# EasyEDA Pro project 3SE_24_Power_Rune.eprj, board 深大PCB参考 (continued)
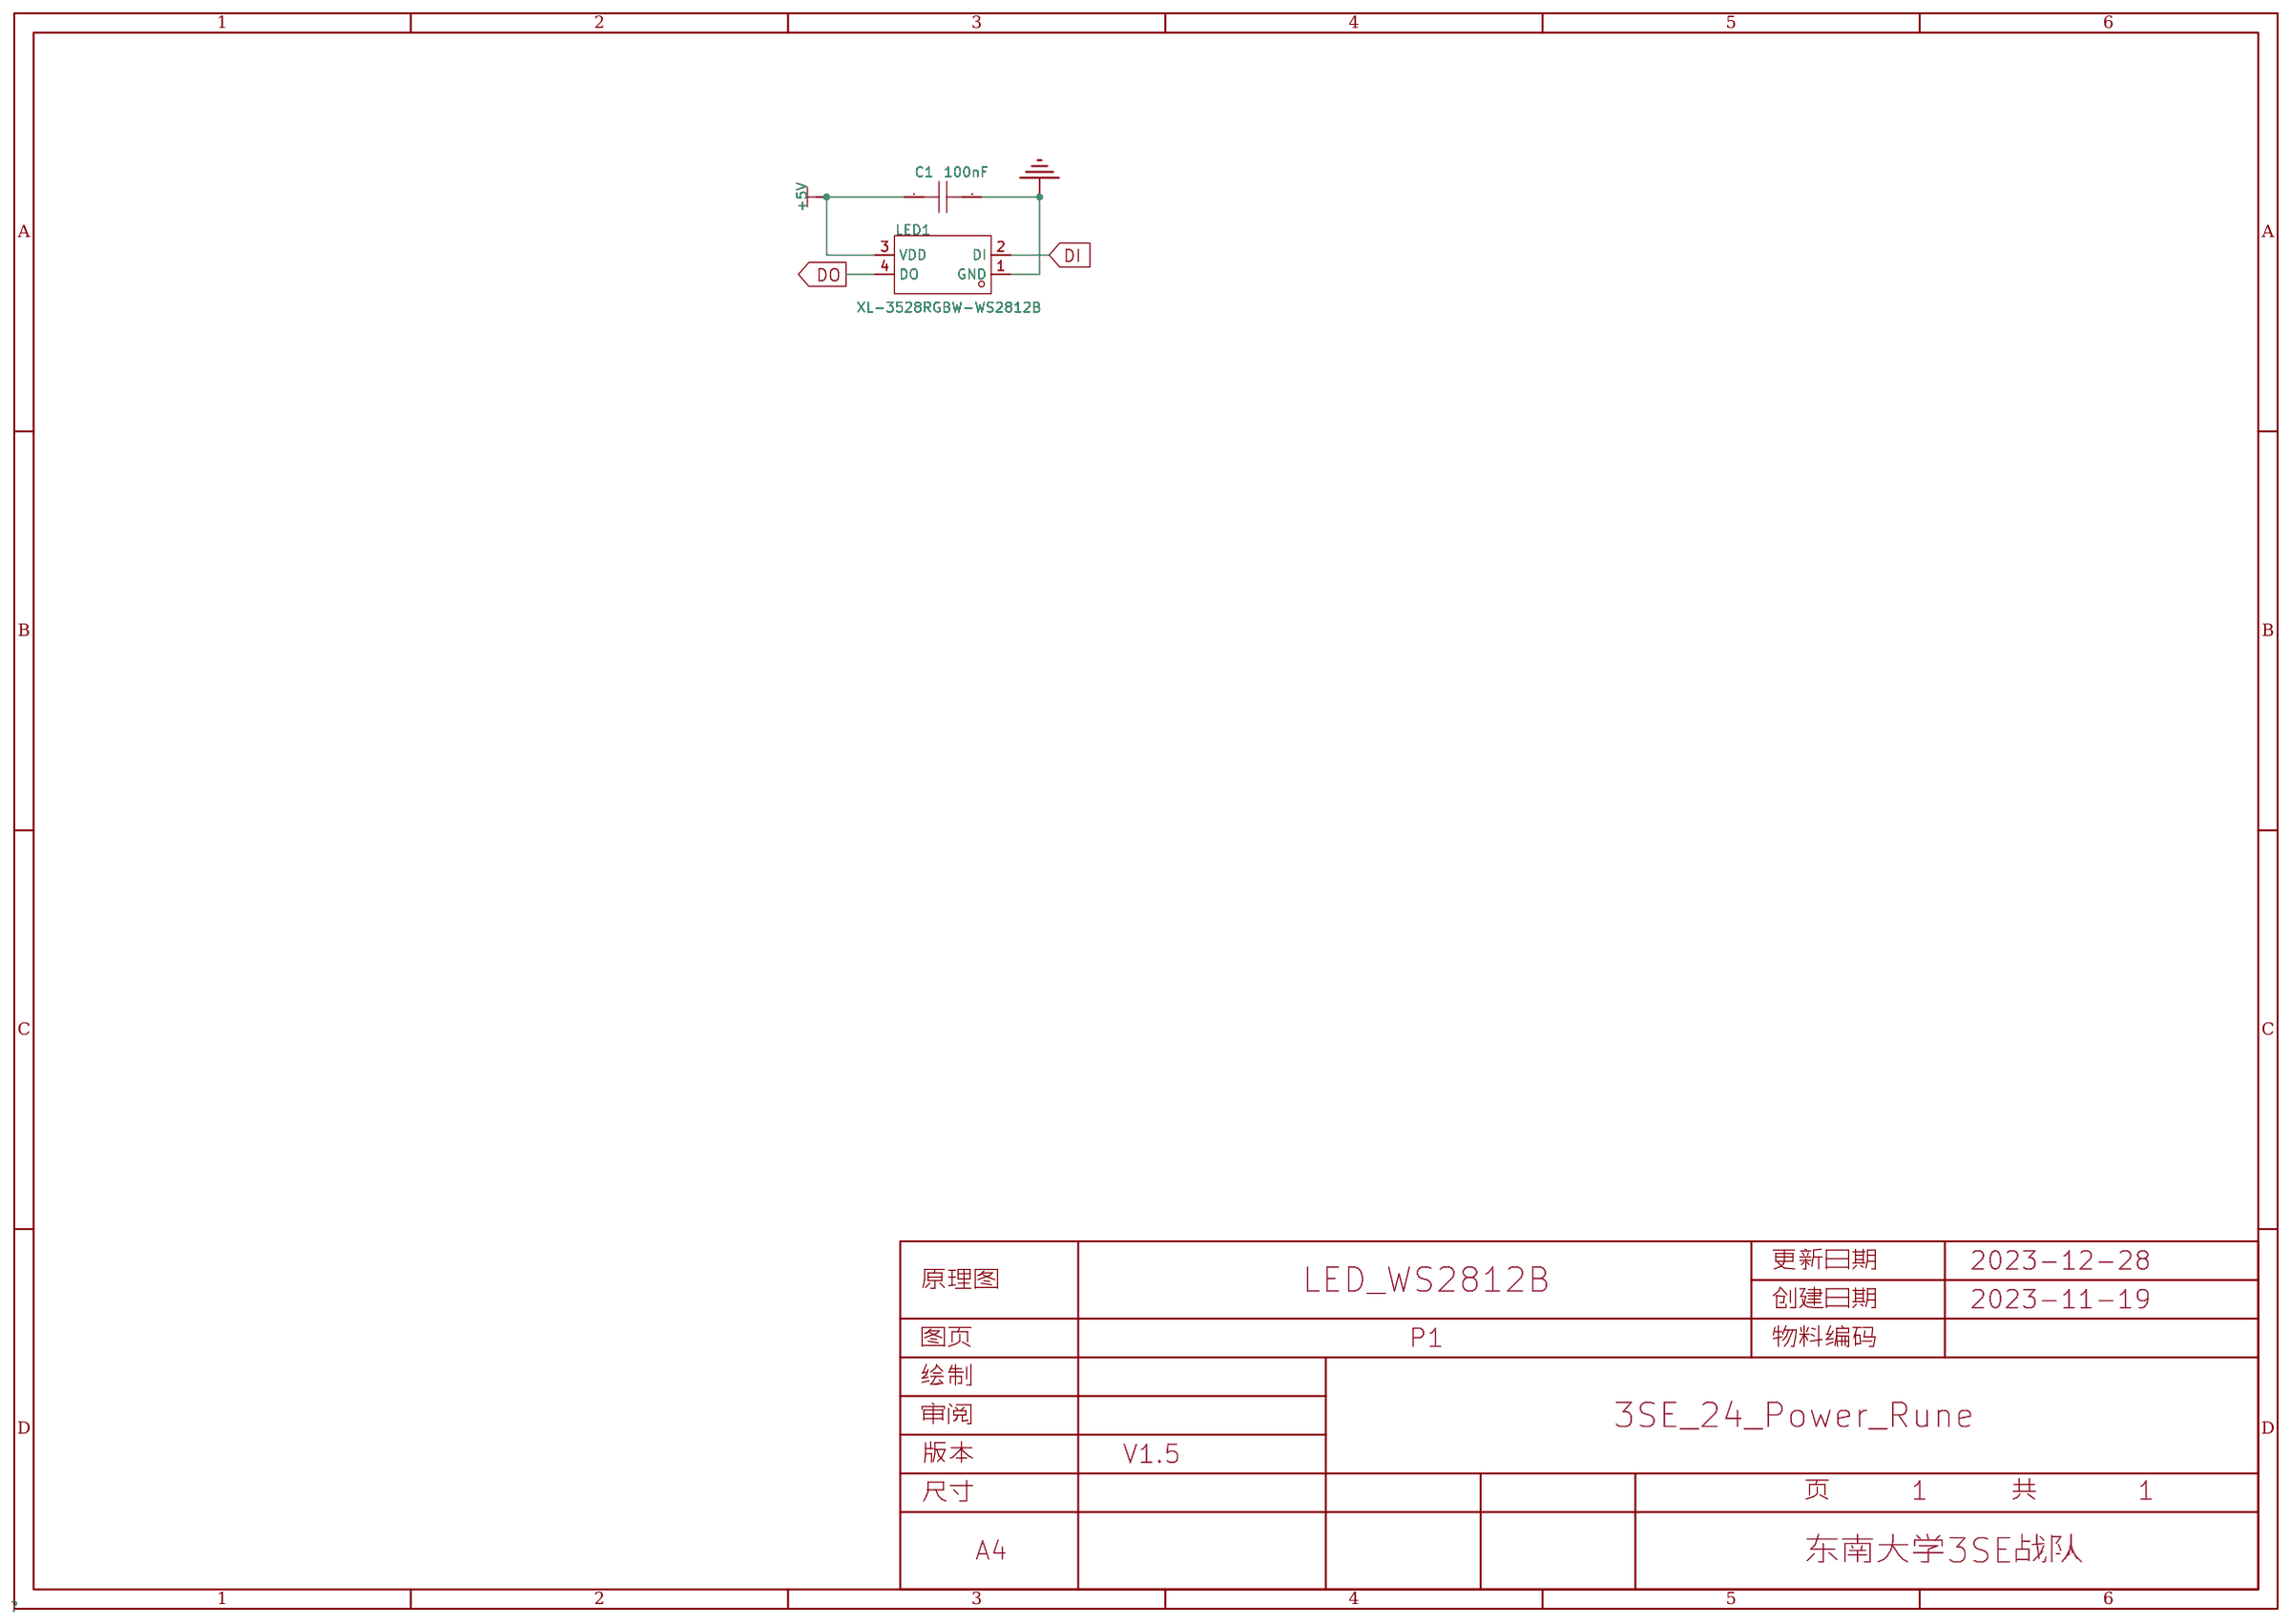
[diagram p0: schematic sheet]
## Nets (continued)
NETD263_2: D263.2 D264.4
NETD264_2: D264.2 D265.4
NETD265_2: D265.2 D266.4
NETD266_2: D266.2 D267.4
NETD267_2: D267.2 D268.4
NETD268_2: D268.2 D269.4
NETD269_2: D269.2 D270.4
NETD270_2: D270.2 D271.4
NETD271_2: D271.2 D272.4
NETD272_2: D272.2 D273.4
NETD273_2: D273.2 D274.4
NETD274_2: D274.2 D275.4
NETD275_2: D275.2 D276.4
NETD276_2: D276.2 D277.4
NETD277_2: D277.2 D278.4
NETD278_2: D278.2 D279.4
NETD279_2: D279.2 D280.4
NETD280_2: D280.2 D281.4
NETD281_2: D281.2 D282.4
NETD282_2: D282.2 D283.4
NETD283_2: D283.2 D284.4
NETD284_2: D284.2 D285.4
NETD285_2: D285.2 D286.4
NETD286_2: D286.2 D287.4
NETD287_2: D287.2 D288.4
NETD288_2: D288.2 D289.4
NETD289_2: D289.2 D290.4
NETD290_2: D290.2 D291.4
NETD291_2: D291.2 D292.4
NETD292_2: D292.2 D293.4
NETD293_2: D293.2 D294.4
NETD294_2: D294.2 D295.4
NETD295_2: D295.2 D296.4
NETD296_2: D296.2 D297.4
NETD297_2: D297.2 D298.4
NETD298_2: D298.2 D299.4
NETD299_2: D299.2 D300.4
NETD300_2: D300.2 D301.4
NETD301_2: D301.2 D302.4
NETD302_2: D302.2 D303.4
NETD303_2: D303.2 D304.4
NETD304_2: D304.2 D305.4
NETD305_2: D305.2 D306.4
NETD306_2: D306.2 D307.4
NETD307_2: D307.2 D308.4
NETD308_2: D308.2 D309.4
NETD309_2: D309.2 D310.4
NETD310_2: D310.2 D311.4
NETD311_2: D311.2 D312.4
NETD312_2: D312.2 D313.4
NETD313_2: D313.2 D314.4
NETD314_2: D314.2 D315.4
NETD315_2: D315.2 D316.4
NETD316_2: D316.2 D317.4
NETD317_2: D317.2 D318.4
NETD318_2: D318.2 D319.4
NETD319_2: D319.2 D320.4
NETD320_2: D320.2 D321.4
NETD321_2: D321.2 D322.4
NETD322_2: D322.2 D323.4
NETD323_2: D323.2 D324.4
NETD324_2: D324.2 D325.4
NETD325_2: D325.2 D326.4
NETD326_2: D326.2 D327.4
NETD327_2: D327.2 D328.4
NETD328_2: D328.2 D329.4
NETD329_2: D329.2 D330.4
NETD330_2: D330.2 D331.4
NETD331_2: D331.2 D332.4
NETD332_2: D332.2 D333.4
NETD333_2: D333.2 D334.4
NETD334_2: D334.2 D335.4
NETD335_2: D335.2 D336.4
NETD336_2: D336.2 D337.4
NETD337_2: D337.2 D338.4
NETD338_2: D338.2 D339.4
NETD339_2: D339.2 D340.4
NETD340_2: D340.2 D341.4
NETD341_2: D341.2 D342.4
NETD342_2: D342.2 D343.4
NETD343_2: D343.2 D344.4
NETD344_2: D344.2 D345.4
NETD345_2: D345.2 D346.4
NETD346_2: D346.2 D347.4
NETD347_2: D347.2 D348.4
NETD348_2: D348.2 D349.4
NETD349_2: D349.2 D350.4
NETD350_2: D350.2 D351.4
NETD351_2: D351.2 D352.4
NETD352_2: D352.2 D353.4
NETD353_2: D353.2 D354.4
NETD354_2: D354.2 D355.4
NETD355_2: D355.2 D356.4
NETD357_2: D357.2 D358.4
NETD358_2: D358.2 D359.4
NETD359_2: D359.2 D360.4
NETD360_2: D360.2 D361.4
NETD361_2: D361.2 D362.4
NETD362_2: D362.2 D363.4
NETD363_2: D363.2 D364.4
NETD364_2: D364.2 D365.4
NETD365_2: D365.2 D366.4
NETD366_2: D366.2 D367.4
NETD367_2: D367.2 D368.4
NETD368_2: D368.2 D369.4
NETD369_2: D369.2 D370.4
NETD370_2: D370.2 D371.4
NETD371_2: D371.2 D372.4
NETD372_2: D372.2 D373.4
NETD373_2: D373.2 D374.4
NETD374_2: D374.2 D375.4
NETD375_2: D375.2 D376.4
NETD376_2: D376.2 D377.4
NETD377_2: D377.2 D378.4
NETD378_2: D378.2 D379.4
NETD379_2: D379.2 D380.4
NETD380_2: D380.2 D381.4
NETD381_2: D381.2 D382.4
NETD382_2: D382.2 D383.4
NETD383_2: D383.2 D384.4
NETD384_2: D384.2 D385.4
NETD385_2: D385.2 D386.4
NETD386_2: D386.2 D387.4
NETD387_2: D387.2 D388.4
NETD388_2: D388.2 D389.4
NETD389_2: D389.2 D390.4
NETD390_2: D390.2 D391.4
NETD391_2: D391.2 D392.4
NETD392_2: D392.2 D393.4
NETD393_2: D393.2 D394.4
NETD394_2: D394.2 D395.4
NETD395_2: D395.2 D396.4
NETD396_2: D396.2 D397.4
NETD397_2: D397.2 D398.4
NETD398_2: D398.2 D399.4
NETD399_2: D399.2 D400.4
NETD400_2: D400.2 D401.4
NETD401_2: D401.2 D402.4
NETD402_2: D402.2 D403.4
NETD403_2: D403.2 D404.4
NETD404_2: D404.2 D405.4
NETD405_2: D405.2 D406.4
NETD406_2: D406.2 D407.4
NETD407_2: D407.2 D408.4
NETD408_2: D408.2 D409.4
NETD409_2: D409.2 D410.4
NETD410_2: D410.2 D411.4
NETD411_2: D411.2 D412.4
NETD412_2: D412.2 D413.4
NETD413_2: D413.2 D414.4
NETD414_2: D414.2 D415.4
NETD415_2: D415.2 D416.4
NETD416_2: D416.2 D417.4
NETD417_2: D417.2 D418.4
NETD418_2: D418.2 D419.4
NETD419_2: D419.2 D420.4
NETD420_2: D420.2 D421.4
NETD421_2: D421.2 D422.4
NETD422_2: D422.2 D423.4
NETD423_2: D423.2 D424.4
NETD424_2: D424.2 D425.4
NETD425_2: D425.2 D426.4
NETD426_2: D426.2 D427.4
NETD427_2: D427.2 D428.4
NETD428_2: D428.2 D429.4
NETD429_2: D429.2 D430.4
NETD430_2: D430.2 D431.4
NETD431_2: D431.2 D432.4
NETD432_2: D432.2 D433.4
NETD433_2: D433.2 D434.4
NETD434_2: D434.2 D435.4
NETD435_2: D435.2 D436.4
NETD436_2: D436.2 D437.4
NETD437_2: D437.2 D438.4
NETD438_2: D438.2 D439.4
NETD439_2: D439.2 D440.4
NETD440_2: D440.2 D441.4
NETD441_2: D441.2 D442.4
NETD442_2: D442.2 D443.4
NETD443_2: D443.2 D444.4
NETD444_2: D444.2 D445.4
NETD445_2: D445.2 D446.4
NETD446_2: D446.2 D447.4
NETD447_2: D447.2 D448.4
NETD448_2: D448.2 D449.4
NETD449_2: D449.2 D450.4
NETD450_2: D450.2 D451.4
NETD451_2: D451.2 D452.4
R_DET1: J13.1 J18.1 SW35.1 SW36.1 SW37.1 SW38.1
R_DET2: J12.1 J18.2 SW31.1 SW32.1 SW33.1 SW34.1
R_DET3: J11.1 J18.4 SW27.1 SW28.1 SW29.1 SW30.1
R_DET4: J10.1 J18.5 SW23.1 SW24.1 SW25.1 SW26.1
R_DET5: J9.1 J18.6 SW19.1 SW20.1 SW21.1 SW22.1
R_DET6: J8.1 J18.7 SW15.1 SW16.1 SW17.1 SW18.1
R_DET7: J7.1 J18.8 SW11.1 SW12.1 SW13.1 SW14.1
R_DET8: .1 J6.1 J18.9 SW7.1 SW9.1 SW10.1
R_DET9: J5.1 J18.10 SW3.1 SW4.1 SW5.1 SW6.1
R_DET10: J4.1 J18.11 SW1.1 SW2.1

Pads without a net:  3; NOREF 1; NOREF#2 1; NOREF#3 1; NOREF#4 1; NOREF#5 1; NOREF#6 1; NOREF#7 1; NOREF#8 1; NOREF#9 1; NOREF#10 1; NOREF#11 1; NOREF#12 1; NOREF#13 1; NOREF#14 1; NOREF#15 1; NOREF#16 1; NOREF#17 1; NOREF#18 1; NOREF#19 1; NOREF#20 1; NOREF#21 1; NOREF#22 1; NOREF#23 tdr; NOREF#24 1; NOREF#25 1; NOREF#26 1; NOREF#27 1; NOREF#28 1; NOREF#29 1; NOREF#30 1; NOREF#31 1; NOREF#32 1; NOREF#33 1; NOREF#34 1; NOREF#35 1; NOREF#36 1; NOREF#37 1; NOREF#38 1; NOREF#39 1; NOREF#40 1; NOREF#41 1; NOREF#42 1; SW1 3; SW2 3; SW3 3; SW4 3; SW5 3; SW6 3; SW7 3; SW9 3; SW10 3; SW11 3; SW12 3; SW13 3; SW14 3; SW15 3; SW16 3; SW17 3; SW18 3; SW19 3; SW20 3; SW21 3; SW22 3; SW23 3; SW24 3; SW25 3; SW26 3; SW27 3; SW28 3; SW29 3; SW30 3; SW31 3; SW32 3; SW33 3; SW34 3; SW35 3; SW36 3; SW37 3; SW38 3

## Via types
v1: diameter 0.711, hole 0.355, Top Layer to Bottom Layer, 46 vias
v2: diameter 0.508, hole 0.305, Top Layer to Bottom Layer, 2 vias
v3: diameter 1.1, hole 0.7, Top Layer to Bottom Layer, 452 vias

## Routing (per net, layer and track width the routed paths; a pad name or vN(x,y) marks a point on that pad's centre or on a via; arc(x,y) is an arc through that point)
GND: length 38.5
  Top Layer w0.508: 183.99,180.97 184.48,180.73 186.55,179.41 ; 191.52,179.83 C443.2 191.52,179.47 186.84,179.33 arc(186.69,179.35) 186.55,179.41 ; D165.3 317.03,68.05 320.11,65.58 ; C105.2 322.94,64.52 320.26,65.5 arc(320.18,65.53) 320.11,65.58
  Bottom Layer w0.508: v1(29.64,189.96) 30.89,190.35 32.24,191.86 J3.2 ; v2(25.33,233.6) v1(30.48,233.6) 30.08,234.85 28.58,236.21 J1.2 ; v1(30.48,155.32) v1(25.33,155.32) 25.73,154.08 27.23,152.72 J2.2
  vias: v1(27.91,233.6) v1(27.91,155.32) v1(29.64,195.11) v1(29.72,192.66) v1(152.02,322.83) v1(154.52,323.6) v1(155.45,308.74) v1(156.95,324.37) v1(157.73,309.25) v1(159.34,294.71) v1(160.4,310.01) v1(161.93,295.28) v1(162.69,279.78) v1(164.97,280.42) v1(166.46,264.23) v1(167.62,281.31) v1(168.91,264.92) v1(170.14,249.5) v1(171.43,265.57) v1(172.59,250.06) v1(175.11,250.84) v1(178.17,244.84) v1(178.82,242.32) v1(179.45,240.03) v1(182.49,230.74) v1(183.13,228.35) v1(183.82,225.77) v1(190.62,217.28) v1(191.26,214.76) v1(191.95,212.3) v1(192.15,198.37) v1(192.23,201.08) v1(192.23,195.93) v1(342.52,220.47) v1(342.52,218.06) v1(342.52,215.65) v1(342.52,213.23) v1(342.52,210.82) v1(342.52,208.41) v1(342.52,205.99)
VCC: length 997.2
  Top Layer w0.508: D437.1 190.92,232.34 ; C17.1 241.86,342.66 ; C433.1 145.74,172.49 ; 30.66,275.77 C43.1 ; v3(323.65,40.82) 323.8,40.67 ; 242.59,344.3 v3(242.59,344.46) 242.36,344.02 ; 164.72,370.3 arc(164.73,370.25) C64.1 ; C164.1 arc(173.29,15.91) 173.3,15.96 ; 192.02,370.68 arc(192.03,370.63) C66.1 ; C125.1 arc(201.64,4.52) 201.66,4.62 ; 205.11,370.93 arc(205.12,370.88) C65.1 ; 164.34,348.83 arc(164.35,348.78) 164.38,348.74 ; 191.9,359.76 arc(191.91,359.71) C67.1 ; C47.1 arc(47.57,330.11) 47.45,330.29 ; 172.49,4.48 arc(172.49,4.46) C124.1 ; 148.94,370.62 arc(148.99,370.36) C69.1 ; 205.11,359.88 arc(205.12,359.83) C70.1 ; 219.33,360.77 arc(219.34,360.72) C74.1 ; C161.1 arc(187.45,16) 187.48,16.16 ; 164.76,361.69 arc(164.75,361.74) D41.1 ; 218.95,371.06 arc(218.96,371.01) C55.1 ; C120.1 arc(201.64,27.51) 201.66,27.61 ; 191.9,348.33 arc(191.91,348.28) C61.1 ; 205.62,348.58 arc(205.62,348.53) C58.1 ; 151.22,349.54 arc(151.28,349.27) 151.43,349.05 ; C24.1 arc(264.51,361.61) 264.69,362.52 ; C163.1 arc(186.88,27.6) 186.89,27.64 ; D100.1 arc(12.92,71.07) 12.91,71.07 ; 218.82,348.58 arc(218.83,348.53) C80.1 ; C140.1 arc(358.07,83.17) 357.12,83.36 ; 187.07,4.4 arc(187.08,4.36) C155.1 ; C54.1 arc(177.4,348.21) 177.42,348.32 ; 150.08,359.77 arc(150.1,359.67) C59.1 ; 173.12,27.62 arc(173.12,27.59) C160.1 ; C162.1 arc(201.64,15.95) 201.66,16.05 ; C68.1 arc(177.65,359.38) 177.67,359.5 ; 177.93,370.68 arc(177.94,370.63) C63.1 ; 159.12,15.99 arc(159.13,15.93) C166.1
  Top Layer w1.27: v3(165.99,139.95) 165.94,139.76 165.88,139.52 C412.1 ; C388.1 161.09,126.16 161.1,126.21 v3(161.16,126.37) ; C206.1 40.3,189.74 v3(40.39,189.83) ; v3(91.11,333.68) C71.1 ; C149.1 86.76,29.68 86.89,29.96 v3(86.93,30.05) 86.96,30.13 ; C245.1 124.06,74 v3(124.87,75.71) ; 240.15,296.16 240.01,295.89 v3(239.1,294.17) ; v3(312.42,334.52) 312.31,334.25 C11.1 ; C116.1 8.76,87.36 v3(10.47,88.09) ; C178.1 294.71,20.09 v3(294.18,21.39) ; 218.82,348.58 v3(218.82,350.48) ; v3(200.02,78.23) 200.05,78.07 200.07,77.97 C285.1 ; 76.27,45.65 v3(76.27,45.83) C109.1 ; 27.35,78.16 27.36,78.17 ; 27.36,78.17 v3(27.34,78.18) C89.1 ; 27.36,78.17 27.44,78.25 27.54,78.25 ; 104.84,106.36 106.32,107.84 v3(106.32,107.89) ; v3(129.88,91.4) 129.72,91.12 128.9,89.63 128.78,89.41 ; v3(31.68,110.81) 30.01,110.15 C138.1 ; C119.1 12.95,71.04 v3(13.08,71.12) ; v3(52.51,322.18) C46.1 ; v3(160.4,260.6) 160.17,260.55 160.15,260.54 C399.1 ; C418.1 140.62,226.34 140.7,226.29 v3(140.84,226.19) ; C391.1 v3(122.15,160.07) ; 165.77,230.56 167.28,230.97 167.79,231.11 v3(167.89,231.14) ; v3(182.75,106.52) 182.79,106.48 C358.1 ; v3(268.63,335.03) 267.98,333.56 C9.1 ; C276.1 299.78,189.78 v3(299.73,189.82) ; v3(295.78,326.52) 295.71,326.36 C33.1 ; C26.1 278.89,358.01 v3(278.89,358.01) ; v3(326.22,78.56) 328.24,77.82 ; v3(171.7,171.45) 171.65,171.45 171.47,171.27 ; v3(205.27,275.38) 206.08,277.38 C375.1 ; 191.9,359.76 v3(191.9,361.53) ; v3(72.95,340.03) 73.15,339.48 C84.1 ; 226.92,193.49 v3(224.92,192.97) 224.92,192.97 224.92,192.98 ; 165.18,198.98 166.51,197.65 166.53,197.65 ; v3(142.62,334.14) 142.4,334.08 142.18,334.02 C216.1 ; v3(39.2,258.6) 39.48,258.52 41,258.08 ; C302.1 118.61,287.61 118.64,287.55 v3(118.75,287.4) ; C37.1 24.12,250.71 v3(24.09,250.72) ; v3(171.54,154.39) 170.9,152.84 C431.1 ; v3(70.1,194.06) 70.07,194.06 D276.1 69.9,194.14 C296.1 ; 316.13,345 v3(316.13,345.1) 315.61,343.77 C35.1 ; C227.1 314.01,261.15 v3(312.36,260.28) 312.32,260.25 ; v3(203.06,290.58) C343.1 ; C243.1 162.38,63.37 162.4,63.55 v3(162.43,63.75) ; v3(98.93,168.91) 98.99,168.74 C365.1 ; C135.1 v3(143.92,18.84) ; C374.1 186.14,278.09 v3(186.06,278) ; 143.34,68.67 143.09,68.01 v3(142.57,66.68) ; v3(251.95,304.38) 252.96,306.15 ; C19.1 v3(233.96,360.21) ; 39.77,84.31 39.87,84.35 v3(41.38,85.04) ; v3(251.69,98.27) C282.1 ; C29.1 v3(291.54,353.68) ; C340.1 139.66,282.28 139.71,282.18 v3(139.83,281.94) ; v3(227.71,137.13) 228.96,135.6 ; v3(300,338.37) 299.99,338.34 299.73,337.63 299.48,336.95 C34.1 ; C407.1 239.15,173.26 237.38,173.81 v3(237.34,173.83) ; 177.93,370.68 v3(177.93,372.33) ; v3(266.89,293.89) C269.1 ; v3(267.9,249.64) C347.1 ; C361.1 140.09,118.86 140.26,119.23 v3(140.33,119.38) ; v3(263.07,87.65) C237.1 ; C207.1 v3(40.98,212.45) ; 35.58,97.13 36.92,97.72 v3(37.21,97.85) ; v3(196.75,47.36) C193.1 ; C263.1 145.97,319.52 v3(146.05,319.53) ; v3(117.27,340.92) C72.1 ; C221.1 231.67,330.82 231.15,329.46 v3(231.12,329.38) ; v3(236.41,277.61) C345.1 ; v3(55.29,346.64) 56.01,344.81 ; 164.72,370.3 v3(164.72,372.2) ; C201.1 v3(66.52,108.35) ; C215.1 v3(124.41,323.71) ; v3(225.04,181.36) 225.26,181.31 C427.1 ; v3(132.26,371.28) C87.1 ; C417.1 131.95,210.9 132.11,210.85 v3(132.21,210.82) ; C436.1 151,218.03 D439.1 152.4,216.67 v3(152.53,216.54) ; C2.1 v3(332.54,250.39) ; C428.1 218.14,168.51 217.62,168.8 v3(217.42,168.91) ; v3(69.11,24.17) 68.91,23.64 C113.1 ; 128.07,147.69 129.35,148.97 v3(129.54,148.97) ; C420.1 162.35,245.64 v3(164.08,246.2) ; v3(85.73,278.24) 85.47,278.47 C259.1 ; 205.11,370.93 v3(205.11,372.75) ; C326.1 168.2,92.95 v3(168.24,93.12) ; v3(103.81,337.49) 104.01,336.94 C79.1 ; C36.1 37,246.42 35.56,246.77 35.2,246.85 v3(35.05,246.89) ; v3(335.42,107.26) 337.52,106.56 C174.1 ; v3(263.75,313.45) C223.1 ; v3(249.53,268.48) 251.24,270.19 C346.1 ; 170.09,169.89 170.09,169.89 171.47,171.27 ; v3(285.92,137.71) 287.59,136.76 287.78,136.66 ; 115.51,165.9 114.87,167.72 v3(114.81,167.89) ; v3(276.61,233.17) C348.1 ; v3(42.29,270.76) 42.51,270.69 42.59,270.66 42.68,270.63 44.17,270.12 ; C292.1 v3(89.28,126.86) ; C21.1 247.16,354.56 v3(247.67,355.84) ; v3(55.37,212.98) 55.18,212.99 55.04,213 C255.1 ; 45.48,71.1 47.24,71.67 v3(47.5,71.76) ; C398.1 v3(148.37,252.39) ; C213.1 v3(94.32,306.09) ; v3(286.79,342.81) 286.78,342.79 286.27,341.3 C28.1 ; 35.2,65.51 35.2,65.56 v3(35.15,65.61) 33.6,64.81 C118.1 ; v3(312.73,50.63) C93.1 ; C306.1 186.27,308.18 v3(186.31,308.14) ; C234.1 300.19,128.03 v3(298.82,128.69) ; v3(72.07,156.08) C294.1 ; v3(60.37,335.59) C86.1 ; v3(9.2,130.89) 7.72,130.25 C91.1 ; v3(157.86,6.6) 157.86,6.48 D131.1 157.9,6.44 C100.1 ; 336.89,196.07 334.71,191.22 arc(334.27,190.69) 333.61,190.47 ; v3(310.72,123.21) C185.1 ; v3(48.35,297.97) C170.1 ; v3(98.64,194.06) C366.1 ; 90.1,42.37 v3(90.19,42.33) C153.1 ; C379.1 264.06,225.34 v3(263.74,225.07) ; v3(113.02,13.59) 112.3,11.65 C95.1 ; C20.1 v3(237.51,370.88) 237.42,370.79 ; C236.1 281.22,104.68 v3(281.03,104.68) ; C145.1 82.48,20.26 v3(82.5,20.31) 82.51,20.36 ; v3(249.42,115.33) 250.92,113.82 C321.1 ; v3(82.61,110.01) 81.08,108.74 arc(80.97,108.67) C248.1 ; C304.1 v3(149.73,305.76) ; v3(220.29,285.58) 221.03,287.22 C344.1 ; v3(242.08,35.91) C103.1 ; C288.1 145.33,81.65 v3(146.03,83.57) ; v3(144.4,194.56) 144.06,194.56 D426.1 144.02,194.53 142.11,194.53 ; v3(240.5,191.01) 240.53,191.05 242.7,191.05 ; v3(253.72,181.71) C382.1 ; v3(204.85,178.94) 204.88,178.94 D444.1 205.08,178.77 206.52,177.33 C442.1 ; v3(318.41,137.14) 320.39,136.34 C184.1 ; v3(182.75,91.91) 182.67,91.82 182.67,89.8 ; v3(324.19,154.27) 324.42,154.21 326.19,153.79 C183.1 ; v3(127,9.78) 126.94,9.59 126.89,9.43 C151.1 ; v3(129.03,193.8) 129.03,193.8 128.82,193.8 128.78,193.76 C416.1 ; C287.1 v3(163.54,78.92) ; C165.1 158.36,29.3 v3(158.37,29.43) ; v3(35.19,303.22) C49.1 ; v3(105.79,159.39) 105.56,159.27 103.61,158.33 C364.1 ; v3(262.5,156.46) C353.1 ; C250.1 62.25,140.51 v3(63.88,141.26) ; v3(235.69,312.69) 236.41,314.41 C267.1 ; C242.1 182.67,60.76 v3(182.63,60.8) ; v3(205.36,138.11) 207.19,138.68 C410.1 ; v3(197.61,190.72) D451.1 197.57,190.71 C450.1 ; 303.02,252.6 302.26,252.19 301.48,251.77 v3(301.1,251.56) ; C333.1 83.8,194.02 ; C362.1 v3(128.58,128.57) ; v3(248.92,164.81) 250.67,164.03 250.89,163.93 ; C156.1 v3(28.43,38.3) ; v3(288.8,113.54) 288.91,113.45 288.98,113.39 C235.1 ; v3(355.69,65.51) C141.1 ; v3(106.81,229.11) 104.97,229.8 C368.1 ; v3(186.36,151.89) C430.1 ; C76.1 85.28,344.68 v3(85.22,344.81) ; v3(231.19,70.03) 231.89,68.34 C239.1 ; 177.42,348.32 v3(177.42,349.98) ; C90.1 v3(117.37,23.79) ; C286.1 182.67,77.09 v3(182.75,77.18) ; 336.51,30.34 334.73,31.68 v3(334.7,31.71) ; C370.1 129.76,258.92 v3(129.76,258.83) ; v3(284.9,190.63) 284.94,190.67 C317.1 ; v3(193.17,164.9) 195.29,165.42 ; v3(339.6,122.05) 339.78,121.99 339.99,121.92 C171.1 ; v3(51.26,137.33) C203.1 ; v3(271.14,267.84) 271.16,267.83 271.32,267.83 272.89,269.4 ; v3(129.08,345.88) C50.1 ; 279.67,304.13 278.31,302.77 v3(278.31,302.56) ; 293.79,268.59 292.89,268 292.17,267.52 v3(291.71,267.22) ; v3(221.11,80.32) C284.1 ; v3(158.62,184.28) 158.72,183.91 159.13,182.28 C445.1 ; v3(323.4,293.07) 321.46,292.38 C8.1 ; C415.1 129.84,171.16 v3(129.79,171.32) ; 107.93,260.18 v3(109.61,258.69) ; C327.1 151.08,96.71 v3(151.67,98.3) ; v3(109.22,364.24) 109.31,364.07 110.07,362.53 110.17,362.34 110.24,362.2 ; 173.3,15.96 v3(173.3,18) ; C214.1 v3(109.09,316.47) ; C152.1 v3(102.39,27.6) ; C60.1 v3(255.29,339.64) ; 313.55,314.87 v3(314.83,316.36) ; 303.67,347.62 v3(304.19,349.29) ; C199.1 v3(90.52,81.97) ; C261.1 v3(113.25,302.11) ; C249.1 71.08,124.27 v3(72.16,124.98) ; v3(219.03,237.01) C423.1 ; C256.1 v3(59.82,230.61) ; C205.1 v3(40.47,176.14) ; C290.1 v3(118.64,99.7) ; v3(120.19,367.84) C52.1 ; C328.1 v3(134.44,105.21) ; v3(55.46,193.93) 55.42,193.89 C254.1 ; C194.1 182.79,47.17 v3(182.75,47.21) ; v3(234.76,88.43) 235.49,86.83 C283.1 ; C359.1 v3(168.79,108.73) ; C1.1 v3(344.61,254.97) ; 354.25,116.89 v3(354.2,116.84) 354.31,116.8 C172.1 ; C92.1 v3(25.96,135.84) ; 187.48,16.16 v3(187.48,18) ; v3(68.25,351.46) C82.1 ; v3(254.89,241.81) 255.08,241.99 C378.1 ; v3(319.83,243.68) C228.1 ; v3(220.49,98.4) 221.43,96.37 221.5,96.37 ; C24.1 264.71,362.62 264.72,362.65 v3(264.8,362.84) ; C22.1 v3(260.25,351.32) ; C159.1 v3(56.03,27.85) ; C108.1 347.26,50.82 v3(345.78,51.3) ; 258.75,24.36 258.6,25.51 v3(258.52,26.13) ; C96.1 v3(12.63,103.07) ; v3(238.7,258.65) 240.03,259.98 240.03,260.04 ; v3(113.03,352.04) 113.08,351.92 C75.1 ; v3(214.87,30.67) 215.05,29.57 C126.1 ; 198.42,216.71 D446.1 v3(196.98,215.27) ; C330.1 v3(107.05,128.41) ; v3(297.88,171.8) 300.35,171.37 ; 219.33,360.77 v3(219.33,362.68) ; v3(199.29,261.61) C401.1 ; D442.1 171.47,171.27 ; C367.1 v3(100.96,212.13) ; 140.24,5.49 v3(140.99,7.28) ; 119.88,59.93 119.96,60.1 v3(120.9,62.09) ; C301.1 106.52,280.88 108.07,279.33 ; C419.1 v3(152.96,238.4) ; v3(203.2,244.86) 203.24,244.97 203.27,245.07 203.31,245.19 203.8,246.76 C422.1 ; v3(281.77,278.53) C270.1 ; v3(80.26,355.98) 80.32,355.86 C83.1 ; v3(209.55,49.62) 209.99,47.34 ; 86.05,158.28 85.54,160.13 85.54,160.15 v3(85.47,160.4) ; 354.25,116.96 354.38,116.91 D178.1 ; v3(262.13,14.22) 262.15,14.11 C146.1 ; C329.1 118.26,114.13 v3(119.7,115.58) ; C400.1 v3(186.02,262.14) ; v3(194.61,123.01) C349.1 ; v3(216.15,125.91) C386.1 ; C356.1 227.24,115.99 226.39,117.5 226.34,117.59 226.3,117.65 v3(226.19,117.86) ; C110.1 10.53,50.5 v3(10.79,50.67) ; v3(330.53,93.07) C139.1 ; C12.1 v3(308.38,324.14) ; 164.34,348.83 v3(164.34,350.61) ; C439.1 206.64,226.18 v3(206.58,226.07) ; 359.74,44.46 359.73,44.46 v3(357.55,45.2) ; v3(244.23,60.35) 245.01,58.54 245.1,58.31 ; 21.29,57.25 v3(23.09,58.24) ; v3(253.25,141.07) C354.1 ; v3(64.69,324.41) C88.1 ; v3(242.16,232.01) C404.1 ; v3(105.09,71.08) 103.72,69.1 C198.1 ; C23.1 251.22,365.49 v3(251.74,366.82) ; v3(159.89,160.66) 159.78,160.66 D428.1 158.37,159.25 C432.1 ; v3(319.91,63.75) 320.11,63.67 320.14,63.66 321.97,62.93 C105.1 ; v3(254.33,284.34) C310.1 ; v3(41.84,150.62) 42.24,148.5 ; v3(279.27,258.2) C312.1 ; v3(219.65,6.83) C121.1 ; 63.05,48.08 v3(63.14,48.05) C112.1 ; C257.1 v3(65.86,247.71) ; 150.08,359.77 v3(150.08,361.52) ; C387.1 v3(178.24,122.44) ; C137.1 v3(134.39,32.55) ; v3(340.95,72.74) C143.1 ; v3(124.71,356.62) 124.77,356.49 C53.1 ; v3(175.51,219.71) 175.29,219.66 C447.1 ; v3(231.65,21.21) 231.68,21.05 231.68,21.05 C144.1 ; v3(224.4,267.11) C376.1 ; v3(76.63,329.11) C81.1 ; C123.1 v3(60.1,38.65) ; v3(136.32,359.97) C77.1 ; 67.69,176.73 v3(69.82,177.15) ; v3(153.16,291.21) 152.93,291.17 C341.1 ; v3(46.16,331.58) 46.69,331.05 47.45,330.29 ; v3(253.37,217.42) 253.31,217.59 253.18,218.01 C405.1 ; C297.1 v3(70.67,213.27) ; v3(269.11,41.02) 269.17,40.83 C167.1 ; C336.1 91.63,230.34 91.66,230.33 v3(91.82,230.25) ; v3(31.84,288.95) 32.44,288.78 33.63,288.43 ; v3(205.09,306.2) 205.44,308.22 ; C411.1 183.3,136.53 v3(183.27,136.56) ; v3(303.13,35.23) C132.1 ; v3(114.55,194.06) 114.55,194.05 D381.1 114.31,194.02 C394.1 ; C99.1 v3(12.71,116.13) ; v3(186.05,337.6) 186.14,337.69 C218.1 ; C27.1 v3(281.69,330.71) ; C449.1 179.8,206.59 v3(179.83,206.63) ; v3(95.05,96.64) 93.7,95.29 93.7,95.29 93.48,95.06 ; 71.91,32.8 v3(72.67,34.46) ; C413.1 150.6,148.12 v3(150.75,148.34) ; v3(276.42,17.24) C324.1 ; C7.1 v3(337.62,298.15) ; 173.82,294.12 v3(174.11,292.23) ; C101.1 v3(28.88,123.77) ; C441.1 v3(211.78,202.06) ; C157.1 v3(39.61,48.39) ; v3(253.4,199.24) C381.1 ; C350.1 v3(282.52,223.39) ; 159.12,15.99 v3(159.12,18) ; C14.1 v3(324.1,326.9) ; C300.1 v3(92.47,262.58) ; C371.1 v3(142.97,267.39) ; v3(227.79,248.17) 229.25,250.03 ; v3(39.5,339.6) C48.1 ; 145.74,172.49 145.51,173.28 145.24,174.22 145.23,174.25 145.22,174.3 v3(145.16,174.5) ; C6.1 v3(326.57,280.24) ; 241.86,342.66 242.36,344.02 ; v3(247.83,77.83) 247.91,77.66 248.53,76.38 C238.1 ; 282.88,43.22 v3(282.88,43.36) C179.1 ; 332.32,314.6 v3(333.99,315.92) ; v3(238.36,125.39) 239.91,123.84 C355.1 ; C43.1 29.28,276.28 v3(29.08,276.35) 28.97,276.34 ; C273.1 308.68,238.34 307.44,237.83 arc(307.29,237.76) v3(307.16,237.67) ; 201.66,16.05 v3(201.66,18) ; 297.75,46.41 297.75,46.29 v3(297.74,46.28) 298.13,45.3 C131.1 ; C253.1 v3(54.49,176.45) ; C260.1 v3(98.66,291.14) ; v3(58.85,265.52) 57.02,266.44 C210.1 ; C278.1 295.16,153.7 293.73,154.16 293.45,154.23 D294.1 ; v3(288.39,31.61) 289.13,29.71 C147.1 ; C4.1 328.72,265.37 328.73,265.37 328.76,265.38 v3(328.93,265.43) ; v3(49.84,308.95) 50.32,308.61 C45.1 ; v3(263.4,130.68) 263.4,130.68 263.55,130.58 265.38,129.41 ; 191.9,348.33 v3(191.9,350.1) ; C173.1 356.27,98.77 v3(354.47,99.51) ; v3(200.51,322.15) C265.1 ; C389.1 144.99,133.68 v3(145.42,134.37) ; C360.1 v3(155.03,113.12) ; C31.1 235.79,104.46 235.28,105.23 v3(235.08,105.54) ; v3(302,107.97) C186.1 ; C10.1 v3(332.36,336.68) ; C280.1 276.9,123.21 v3(276.73,123.32) ; D140.1 v3(201.66,5.53) 201.66,4.62 ; v3(281.59,168.24) C318.1 ; v3(328.36,208.39) C230.1 ; v3(222.53,301.5) 222.56,301.58 223.08,303.1 C308.1 ; C187.1 290.73,95.29 v3(290.6,95.29) ; v3(211.45,109.15) C357.1 ; v3(226.31,51.24) C191.1 ; C217.1 163.82,337.23 163.93,336.55 164,336.09 v3(164.11,335.42) ; v3(245.73,23.59) 246.05,21.57 ; v3(255.68,38.19) 255.84,36.43 ; C15.1 v3(320.97,306.69) ; C331.1 v3(96.89,143.29) ; v3(228.48,33.11) C176.1 ; v3(201.93,152.33) C429.1 ; J17.2 337.9,196.81 arc(337.3,196.57) 336.89,196.07 ; v3(284.27,203.55) C316.1 ; v3(356.19,132.99) C175.1 ; v3(217.62,18.75) C122.1 ; 168.56,309.13 v3(168.89,306.99) ; C246.1 v3(109.23,85.13) ; v3(260.27,68.93) C189.1 ; v3(269.82,215.06) D367.1 ; v3(164.72,321.69) 164.52,322.37 C251.1 ; v3(230.65,224.1) C424.1 ; v3(46.31,283.62) 46.59,283.54 47.99,283.13 48.25,283.05 ; C402.1 216.1,254.83 v3(216.03,254.64) ; 75.51,94.97 v3(76.97,96.43) ; v3(82.64,247.36) 80.87,248.18 80.64,248.29 ; v3(195.68,61.87) C241.1 ; v3(186.05,292.52) 186.02,292.56 C342.1 ; v3(190.88,231.9) 190.92,232.16 191.04,232.99 C438.1 ; v3(275.16,79.37) 276.71,77.44 ; 270.67,112.18 269.02,113.82 269.02,113.88 v3(268.86,114.05) ; 54.33,123.17 v3(56.52,124.28) ; 187.07,4.4 v3(187.07,6.44) ; v3(248.16,322.58) C222.1 ; v3(313.84,205.41) 313.96,205.53 316.16,205.53 ; C104.1 v3(333.08,57.49) 333.01,57.49 332.92,57.4 ; v3(344.55,136.53) 344.73,136.46 344.95,136.38 346.45,135.85 C180.1 ; v3(248.55,11.49) C107.1 ; v3(114.43,143.64) 114.28,143.53 114.28,143.53 C363.1 ; C111.1 22.1,92.82 v3(23.74,93.49) ; 201.66,27.61 v3(201.66,29.55) ; v3(323.65,40.82) C129.1 ; C150.1 v3(106.23,40.37) ; 173.12,27.62 v3(173.12,29.55) ; C209.1 v3(50.53,246.15) ; v3(294.44,287.91) 296.11,289.45 ; C414.1 v3(138.66,160.71) ; 176.11,280 v3(176.26,277.94) ; v3(186.05,248.25) 186.02,248.28 C421.1 ; v3(146.69,206.88) 146.55,206.93 C435.1 ; v3(100,347.91) C78.1 ; v3(56.32,153.8) C252.1 ; 205.11,359.88 v3(205.11,361.66) ; v3(315.63,190.25) 315.67,190.29 C231.1 ; 312.22,233.15 v3(312.87,231.27) ; 223.32,212.31 v3(223.84,210.44) ; v3(200.21,92.71) C323.1 ; C372.1 v3(156.97,275.41) ; v3(132.57,238.21) 131.27,239.51 C397.1 ; v3(327.85,172.09) 330.2,171.83 ; C258.1 v3(74.73,263.67) ; C233.1 306.69,145.23 306.57,145.27 v3(306.44,145.32) ; C443.1 191.6,177.8 v3(189.23,177.8) 189.01,177.8 188.89,177.67 ; C115.1 39.8,84.28 ; C264.1 186.14,323.54 v3(186.18,323.51) ; v3(343.78,87.78) C393.1 ; C293.1 v3(80.18,142.53) ; v3(288.38,242.53) 290.23,243.36 C313.1 ; 146.84,27.97 v3(147.6,29.52) ; C25.1 v3(273.58,346.75) ; v3(229.02,158.46) C408.1 ; C195.1 v3(159.34,49.97) ; C314.1 v3(296.87,227.33) ; C3.1 v3(341.99,269.27) ; 333.6,190.47 331.6,190.39 331.59,190.39 v3(329.47,190.5) ; v3(213.56,334.15) C220.1 ; C262.1 v3(129.57,310.9) ; 177.67,359.5 D44.1 ; v3(240.56,149.77) C384.1 ; v3(302.79,275.74) C226.1 ; v3(273.89,146.02) 275.79,145.07 ; 148.94,370.62 v3(148.94,372.19) ; 308.54,24.31 308.54,24.2 v3(308.53,24.18) 308.93,23.2 C127.1 ; v3(26.5,262.91) 28.43,262.4 ; 97.31,15.15 v3(98.07,16.8) ; v3(273.85,28.92) C168.1 ; C158.1 v3(50.78,58.49) ; C196.1 v3(140.65,55.43) ; v3(234.51,9.24) 234.88,7.22 ; 218.95,371.06 v3(218.95,372.75) ; v3(268.35,173.44) 268.6,173.38 270.35,172.96 C352.1 ; C211.1 v3(68.97,278.62) ; 205.62,348.58 v3(205.62,350.45) ; v3(270.55,190.75) 270.58,190.79 C351.1 ; C396.1 123.86,227.58 123.89,227.56 v3(124.08,227.46) ; C212.1 v3(78.08,290.41) ; v3(356.83,83.36) C140.1 ; C229.1 v3(326.33,234.06) ; 121.07,33.26 v3(121.82,35.35) ; 171.24,193.8 C452.1 ; 186.89,27.64 v3(186.89,29.55) ; C5.1 v3(339.33,283.87) ; 133.35,298.71 v3(134.28,296.63) ; v3(199.92,336.22) C219.1 ; 219.01,320.6 218.94,320.36 218.49,318.84 v3(218.43,318.65) ; C136.1 v3(130.77,20.74) ; C395.1 v3(116.98,211.42) ; v3(95.68,360.48) C73.1 ; C18.1 v3(229.79,347.93) ; C335.1 v3(86.34,213.13) ; 98.16,247.45 v3(99.93,246.35) ; v3(216.15,146.56) 216.31,146.37 C409.1 ; 83.04,176.86 v3(85.28,177.25) ; v3(311.91,162.69) C232.1 ; v3(37.85,317.63) C44.1 ; C298.1 v3(75.31,230.78) ; 172.49,4.48 v3(172.49,6.44) ; 192.02,370.68 v3(192.02,372.58) ; 276.53,233.27 276.61,233.27 ; v3(139.88,348.92) C169.1 ; C339.1 v3(124.33,272.67) ; C62.1 164.76,361.69 ; 151.22,349.54 v3(151.22,350.98) ; C208.1 v3(44.45,230.25) ; C425.1 v3(238.7,212.72) ; v3(222.25,65.08) C240.1 ; C369.1 v3(116.07,244.5) ; v3(298.71,208.05) C315.1
  vias: v3(83.91,193.93) v3(108.15,279.25) v3(164.82,360.76) v3(165.09,199.05) v3(171.23,193.8) v3(177.61,360.44) v3(293.44,154.19)
